# Altium schematic sheet RV901-cnc.SchDoc
size A3; SheetNumber: 1; SheetTotal: 8
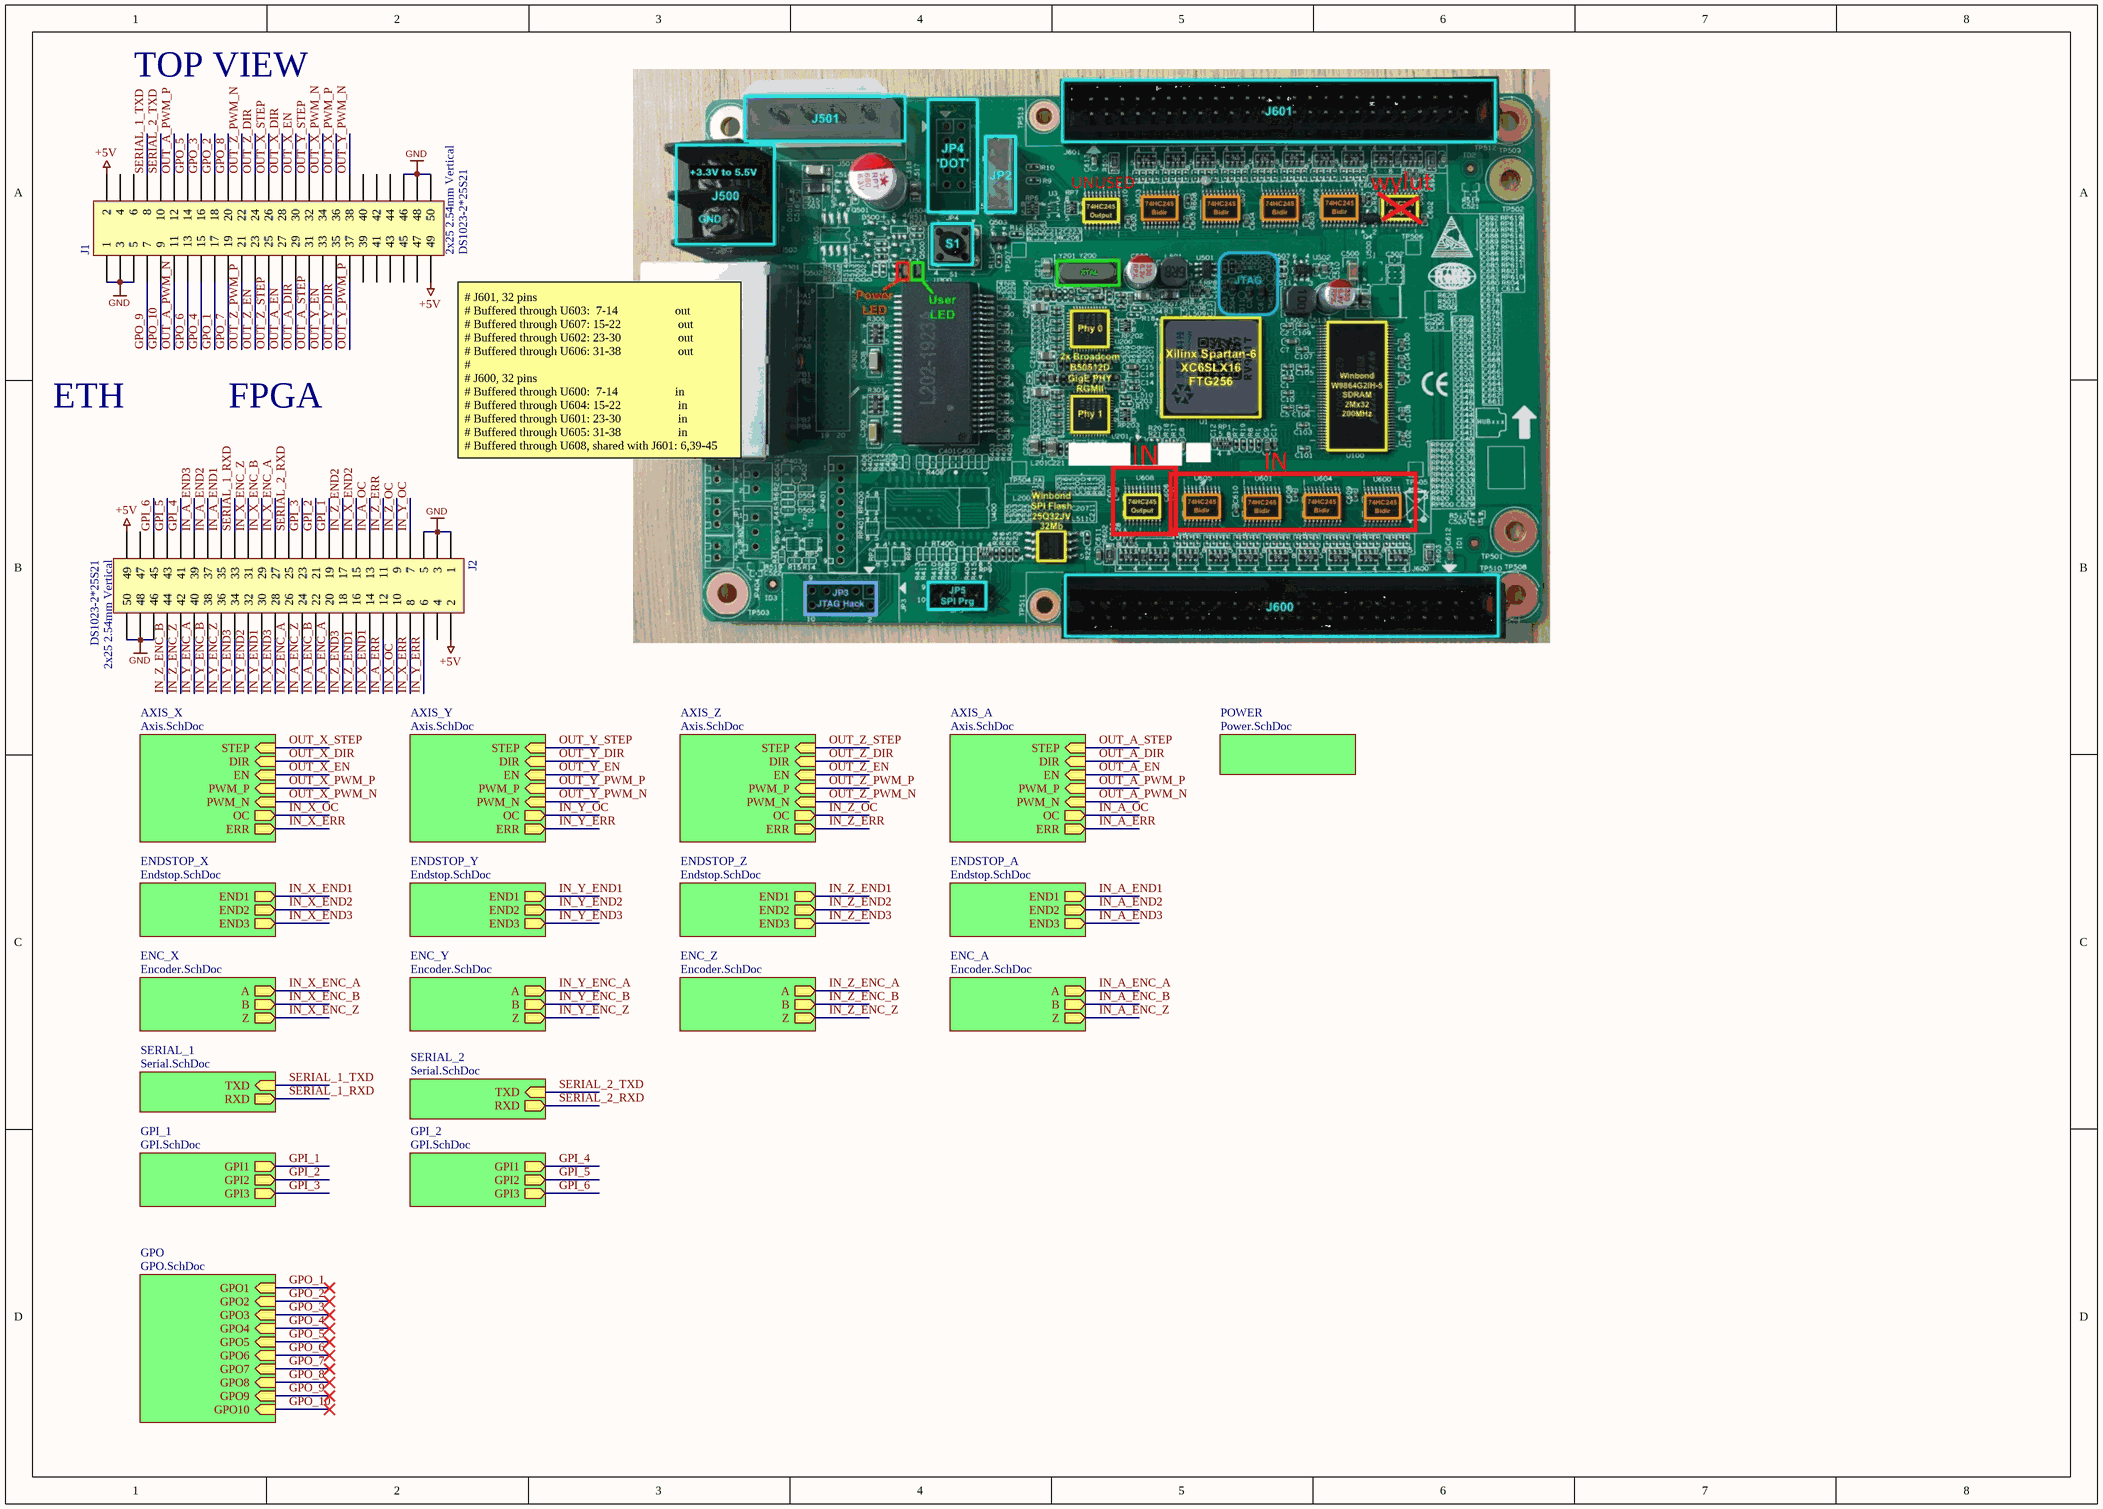
[diagram p0: RV901-cnc.SchDoc]

## Parts
J1  value DS1023-2*25S21  SCH_Footprint: 2x25 2.54mm Vertical  [J_HEADER_2x25_2.54_VERTICAL]  (hidden comment: Goldpin female straight)
J2  value DS1023-2*25S21  SCH_Footprint: 2x25 2.54mm Vertical  [J_HEADER_2x25_2.54_VERTICAL]  (hidden comment: Goldpin female straight)

## Sub-sheets
AXIS_A = Axis.SchDoc: STEP (in), DIR (in), EN (in), PWM_P (in), OC (out), ERR (out), PWM_N (in)
AXIS_X = Axis.SchDoc: STEP (in), DIR (in), EN (in), PWM_P (in), OC (out), ERR (out), PWM_N (in)
AXIS_Y = Axis.SchDoc: STEP (in), DIR (in), EN (in), PWM_P (in), OC (out), ERR (out), PWM_N (in)
AXIS_Z = Axis.SchDoc: STEP (in), DIR (in), EN (in), PWM_P (in), OC (out), ERR (out), PWM_N (in)
ENC_A = Encoder.SchDoc: A (out), B (out), Z (out)
ENC_X = Encoder.SchDoc: A (out), B (out), Z (out)
ENC_Y = Encoder.SchDoc: A (out), B (out), Z (out)
ENC_Z = Encoder.SchDoc: A (out), B (out), Z (out)
ENDSTOP_A = Endstop.SchDoc: END1 (out), END2 (out), END3 (out)
ENDSTOP_X = Endstop.SchDoc: END1 (out), END2 (out), END3 (out)
ENDSTOP_Y = Endstop.SchDoc: END1 (out), END2 (out), END3 (out)
ENDSTOP_Z = Endstop.SchDoc: END1 (out), END2 (out), END3 (out)
GPI_1 = GPI.SchDoc: GPI1 (out), GPI2 (out), GPI3 (out)
GPI_2 = GPI.SchDoc: GPI1 (out), GPI2 (out), GPI3 (out)
GPO = GPO.SchDoc: GPO1 (in), GPO2 (in), GPO3 (in), GPO4 (in), GPO5 (in), GPO6 (in), GPO7 (in), GPO8 (in), GPO9 (in), GPO10 (in)
POWER = Power.SchDoc: no entries
SERIAL_1 = Serial.SchDoc: TXD (in), RXD (out)
SERIAL_2 = Serial.SchDoc: TXD (in), RXD (out)

## Nets
+5V: J1.2 J1.49 J2.2 J2.49
GND: J1.1 J1.3 J1.5 J1.46 J1.48 J1.50 J2.1 J2.3 J2.5 J2.46 J2.48 J2.50
GPI_1: J2.19 ; sheet GPI_1/GPI1
GPI_2: J2.21 ; sheet GPI_1/GPI2
GPI_3: J2.23 ; sheet GPI_1/GPI3
GPI_4: J2.41 ; sheet GPI_2/GPI1
GPI_5: J2.43 ; sheet GPI_2/GPI2
GPI_6: J2.45 ; sheet GPI_2/GPI3
GPO_1: J1.17 ; sheet GPO/GPO1
GPO_2: J1.18 ; sheet GPO/GPO2
GPO_3: J1.16 ; sheet GPO/GPO3
GPO_4: J1.15 ; sheet GPO/GPO4
GPO_5: J1.14 ; sheet GPO/GPO5
GPO_6: J1.13 ; sheet GPO/GPO6
GPO_7: J1.19 ; sheet GPO/GPO7
GPO_8: J1.20 ; sheet GPO/GPO8
GPO_9: J1.7 ; sheet GPO/GPO9
GPO_10: J1.9 ; sheet GPO/GPO10
IN_A_ENC_A: J2.20 ; sheet ENC_A/A
IN_A_ENC_B: J2.22 ; sheet ENC_A/B
IN_A_ENC_Z: J2.24 ; sheet ENC_A/Z
IN_A_END1: J2.35 ; sheet ENDSTOP_A/END1
IN_A_END2: J2.37 ; sheet ENDSTOP_A/END2
IN_A_END3: J2.39 ; sheet ENDSTOP_A/END3
IN_A_ERR: J2.12 ; sheet AXIS_A/ERR
IN_A_OC: J2.13 ; sheet AXIS_A/OC
IN_X_ENC_A: J2.27 ; sheet ENC_X/A
IN_X_ENC_B: J2.29 ; sheet ENC_X/B
IN_X_ENC_Z: J2.31 ; sheet ENC_X/Z
IN_X_END1: J2.14 ; sheet ENDSTOP_X/END1
IN_X_END2: J2.15 ; sheet ENDSTOP_X/END2
IN_X_END3: J2.28 ; sheet ENDSTOP_X/END3
IN_X_ERR: J2.8 ; sheet AXIS_X/ERR
IN_X_OC: J2.10 ; sheet AXIS_X/OC
IN_Y_ENC_A: J2.40 ; sheet ENC_Y/A
IN_Y_ENC_B: J2.38 ; sheet ENC_Y/B
IN_Y_ENC_Z: J2.36 ; sheet ENC_Y/Z
IN_Y_END1: J2.30 ; sheet ENDSTOP_Y/END1
IN_Y_END2: J2.32 ; sheet ENDSTOP_Y/END2
IN_Y_END3: J2.34 ; sheet ENDSTOP_Y/END3
IN_Y_ERR: J2.6 ; sheet AXIS_Y/ERR
IN_Y_OC: J2.7 ; sheet AXIS_Y/OC
IN_Z_ENC_A: J2.26 ; sheet ENC_Z/A
IN_Z_ENC_B: J2.44 ; sheet ENC_Z/B
IN_Z_ENC_Z: J2.42 ; sheet ENC_Z/Z
IN_Z_END1: J2.16 ; sheet ENDSTOP_Z/END1
IN_Z_END2: J2.17 ; sheet ENDSTOP_Z/END2
IN_Z_END3: J2.18 ; sheet ENDSTOP_Z/END3
IN_Z_ERR: J2.11 ; sheet AXIS_Z/ERR
IN_Z_OC: J2.9 ; sheet AXIS_Z/OC
OUT_A_DIR: J1.29 ; sheet AXIS_A/DIR
OUT_A_EN: J1.27 ; sheet AXIS_A/EN
OUT_A_PWM_N: J1.11 ; sheet AXIS_A/PWM_N
OUT_A_PWM_P: J1.12 ; sheet AXIS_A/PWM_P
OUT_A_STEP: J1.31 ; sheet AXIS_A/STEP
OUT_X_DIR: J1.28 ; sheet AXIS_X/DIR
OUT_X_EN: J1.30 ; sheet AXIS_X/EN
OUT_X_PWM_N: J1.34 ; sheet AXIS_X/PWM_N
OUT_X_PWM_P: J1.36 ; sheet AXIS_X/PWM_P
OUT_X_STEP: J1.26 ; sheet AXIS_X/STEP
OUT_Y_DIR: J1.35 ; sheet AXIS_Y/DIR
OUT_Y_EN: J1.33 ; sheet AXIS_Y/EN
OUT_Y_PWM_N: J1.38 ; sheet AXIS_Y/PWM_N
OUT_Y_PWM_P: J1.37 ; sheet AXIS_Y/PWM_P
OUT_Y_STEP: J1.32 ; sheet AXIS_Y/STEP
OUT_Z_DIR: J1.24 ; sheet AXIS_Z/DIR
OUT_Z_EN: J1.23 ; sheet AXIS_Z/EN
OUT_Z_PWM_N: J1.22 ; sheet AXIS_Z/PWM_N
OUT_Z_PWM_P: J1.21 ; sheet AXIS_Z/PWM_P
OUT_Z_STEP: J1.25 ; sheet AXIS_Z/STEP
SERIAL_1_RXD: J2.33 ; sheet SERIAL_1/RXD
SERIAL_1_TXD: J1.8 ; sheet SERIAL_1/TXD
SERIAL_2_RXD: J2.25 ; sheet SERIAL_2/RXD
SERIAL_2_TXD: J1.10 ; sheet SERIAL_2/TXD

Not connected (* = marked no-connect by the designer): J1 4 6 39 40 41 42 43 44 45 47; J2 4 47

## Notes on the sheet
- TOP VIEW
- ETH
- FPGA
- (near J1) # J601, 32 pins
  # Buffered through U603:  7-14                   out
  # Buffered through U607: 15-22                   out
  # Buffered through U602: 23-30                   out
  # Buffered through U606: 31-38                   out
  #
  # J600, 32 pins
  # Buffered through U600:  7-14                   in
  # Buffered through U604: 15-22                   in
  # Buffered through U601: 23-30                   in
  # Buffered through U605: 31-38                   in
  # Buffered through U608, shared with J601: 6,39-45 out

## Library data of the parts
J1 J2 = J_HEADER_2x25_2.54_VERTICAL: Pin Header; Manufacturer: Connfly; Part Number: J_HEADER_2x25_2.54_VERTICAL; HelpURL: https://www.tme.eu/Document/fb46b5bf61a00a652e5b61675362b1db/DS1023.pdf; Manufacturer Part Number: DS1023-2*25S21; Supplier 1: TME; Supplier Part Number 1: ZL262-50DG; Supplier 2: RS Components; Supplier 3: Farnell; Supplier 4: Mouser; Supplier 5: Digi-Key; Supplier 6: LCSC